# EasyEDA Pro project 智能车.eprj, board PCB1
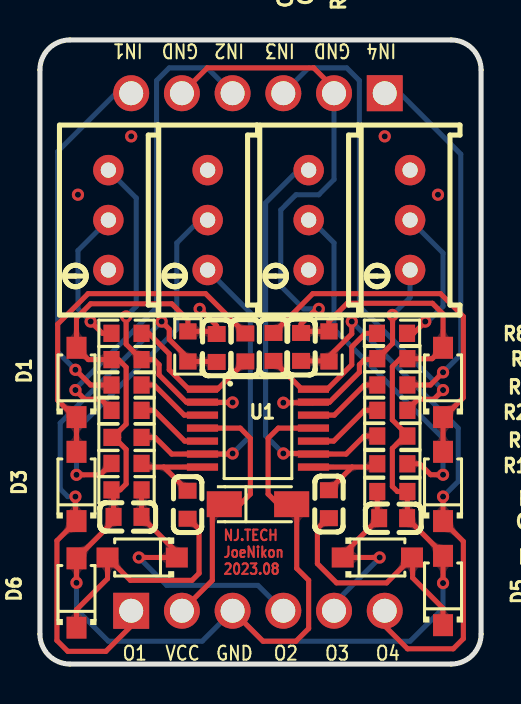
[diagram p10: board, top side]
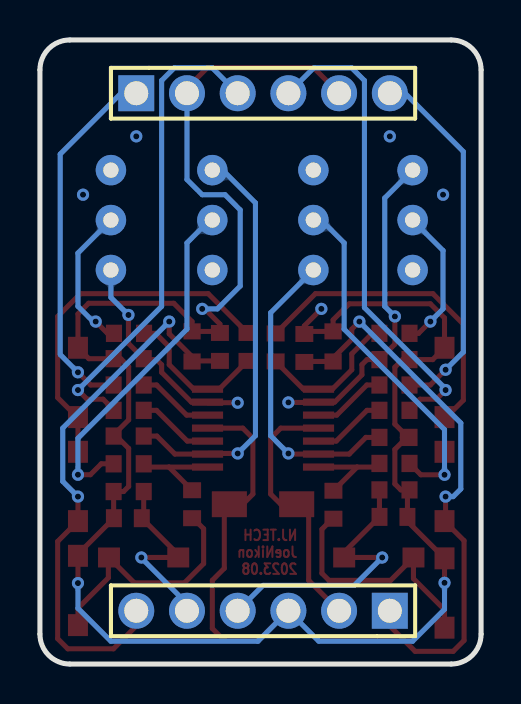
[diagram p11: board, bottom side, seen from below]

Outline 22.1 x 31.24 mm; copper layers: Top Layer, Bottom Layer. Coordinates in mm from the lower left corner of the outline.
Outline path: 0,29.74 0,1.5 arc(0.44,0.44) 1.5,0 20.6,0 arc(21.66,0.44) 22.1,1.5 22.1,29.74 arc(21.66,30.8) 20.6,31.24 1.5,31.24 arc(0.44,30.8) 0,29.74
Stack: Top Layer 0.035mm / Dielectric1 1.51mm FR4 er 4.5 / Bottom Layer 0.035mm

## Design rules (mm)
template: JLCPCB Capability(Two Layers Board)
spacing copperThickness1oz (default): track to track 0.102, other pairs 0.152 to 0.3
spacing copperThickness2oz: track to track 0.203, other pairs 0.152 to 0.3
track width copperThickness1oz (default): min 0.127, default 0.254, max 2.54
track width copperThickness2oz: min 0.203, default 0.254, max 2.54
differential pair differentialPair (default): width min 0.127, default 0.254, max 2.54; gap min 0.152, default 0.152
via viaSize (default): diameter min 0.5, default 0.61, max 10; hole min 0.3, default 0.305, max 6.3

## Placement (name value [footprint] x y rotation side)
C1  100nF  [C0603]  10.29 15.85 90 top
C2  100nF  [C0603]  8.85 15.82 270 top
C3  100nF  [C0603]  13.08 15.88 90 top
C4  100nF  [C0603]  11.7 15.88 90 top
C5  100nF  [C0603]  14.48 8 270 top
C6  100nF  [C0603]  17.69 7.3 180 top
C7  100nF  [C0603]  4.39 7.37 180 top
C8  100nF  [C0603]  7.39 7.97 270 top
D1  B5819W  [SOD-123F_L2.7-W1.6-LS3.8-RD-1]  1.83 14.1 90 top
D2  B5819W  [SOD-123F_L2.7-W1.6-LS3.8-RD-1]  20.19 14.1 90 top
D3  B5819W  [SOD-123F_L2.7-W1.6-LS3.8-RD-1]  1.83 8.89 90 top
D4  B5819W  [SOD-123F_L2.7-W1.6-LS3.8-RD-1]  20.19 8.89 90 top
D5  B5819W  [SOD-123F_L2.7-W1.6-LS3.8-RD-1]  20.19 3.68 90 top
D6  B5819W  [SOD-123F_L2.7-W1.6-LS3.8-RD-1]  1.83 3.56 90 top
D7  B5819W  [SOD-123F_L2.7-W1.6-LS3.8-RD-1]  16.9 5.33 0 top
D8  B5819W  [SOD-123F_L2.7-W1.6-LS3.8-RD-1]  5.12 5.33 180 top
H1  -  [HDR-TH_6P-P2.54-V-M-1]  10.92 2.67 0 bottom
H2  -  [HDR-TH_6P-P2.54-V-M-1]  10.92 28.57 180 bottom
O1  10uF  [CAP-SMD_L3.2-W1.6-RD-C7171]  10.92 8 0 top
R1  1K  [R0603]  4.34 15.24 0 top
R2  100kΩ  [RES-ADJ-TH_3P-L10.0-W10.0-P2.50-L]  3.43 22.22 90 top
R3  47K  [R0603]  4.34 16.55 0 top
R4  47K  [R0603]  7.41 15.9 270 top
R5  47K  [R0603]  14.48 15.9 90 top
R6  1K  [R0603]  17.65 15.28 0 top
R7  100kΩ  [RES-ADJ-TH_3P-L10.0-W10.0-P2.50-L]  18.54 22.22 90 top
R8  47K  [R0603]  17.64 16.55 0 top
R9  1K  [R0603]  17.65 11.41 180 top
R10  100kΩ  [RES-ADJ-TH_3P-L10.0-W10.0-P2.50-L]  13.46 22.22 90 top
R11  47K  [R0603]  17.65 10.02 180 top
R12  47K  [R0603]  17.65 8.64 180 top
R13  47K  [R0603]  4.34 8.72 180 top
R14  1K  [R0603]  4.34 11.35 180 top
R15  100kΩ  [RES-ADJ-TH_3P-L10.0-W10.0-P2.50-L]  8.4 22.22 90 top
R16  47K  [R0603]  4.34 10.04 180 top
R17  5.1K  [R0603]  4.34 12.7 0 top
R18  5.1K  [R0603]  4.34 13.97 0 top
R19  5.1K  [R0603]  17.65 13.97 0 top
R20  5.1K  [R0603]  17.65 12.7 0 top
U1  -  [TSSOP-14_L4.9-W4.4-P0.65-LS6.4-BL]  10.92 11.81 270 top

## Footprints (pads in the part's own frame, mm; a bottom-side part is the same pattern mirrored in y, then rotated)
C0603
  rect 0.8x0.9 smd: 1(-0.7,0) 2(0.7,0)
CAP-SMD_L3.2-W1.6-RD-C7171
  rect 1.758x1.296 smd: 1(-1.687,0) 2(1.687,0)
HDR-TH_6P-P2.54-V-M-1
  rect 1.8x1.8 hole 1.2: 1(-6.35,0)
  round 1.8 hole 1.2: 2(-3.81,0) 3(-1.27,0) 4(1.27,0) 5(3.81,0) 6(6.35,0)
R0603
  rect 0.806x0.864 smd: 1(-0.753,0) 2(0.753,0)
RES-ADJ-TH_3P-L10.0-W10.0-P2.50-L
  round 1.524 hole 0.762: 1(-2.5,0) 2(0,0) 3(2.5,0)
SOD-123F_L2.7-W1.6-LS3.8-RD-1
  rect 1.1x1 smd: 1(-1.735,0) 2(1.735,0)
TSSOP-14_L4.9-W4.4-P0.65-LS6.4-BL
  rect 0.364x1.56 smd: 1(-1.95,-2.78) 2(-1.3,-2.78) 3(-0.65,-2.78) 4(0,-2.78) 5(0.65,-2.78) 6(1.3,-2.78) 7(1.95,-2.78) 8(1.95,2.78) 9(1.3,2.78) 10(0.65,2.78) 11(0,2.78) 12(-0.65,2.78) 13(-1.3,2.78) 14(-1.95,2.78)

## Nets
As in the schematic, except:
GND: C2.1 C3.2 C6.1 C7.2 D1.2 D2.2 D5.2 D6.2 H1.3 H2.2 H2.5 O1.2 R1.1 R4.1 R5.2 R6.2 R9.1 R12.1 R13.2 R14.2 U1.11
VCC: H1.2 O1.1 U1.4

Pads without a net: R2 1; R7 3; R10 1; R15 3

## Via types
v1: diameter 0.61, hole 0.305, Top Layer to Bottom Layer, 28 vias

## Routing (per net, layer and track width the routed paths; a pad name or vN(x,y) marks a point on that pad's centre or on a via; arc(x,y) is an arc through that point)
GND: length 118.6
  Top Layer w0.254: U1.11 11.94,11.81 11.43,11.3 11.43,8.51 11.94,8 O1.2 12.86,7.75 12.86,4.79 13.46,4.19 13.46,1.78 12.83,1.14 11.18,1.14 H1.3 ; 18.18,11.41 18.18,11.7 17.65,12.22 17.65,14.89 18.05,15.28 R6.2 19.65,15.28 D2.2 20.19,17.53 19.66,18.06 15.39,18.06 14.48,17.14 14.48,16.65 13.16,16.65 C3.2 13.08,17.02 13.84,17.78 v1(13.97,17.78) ; 18.18,11.41 18.18,11.32 17.65,10.79 17.65,8.89 17.91,8.64 R12.1 18.41,7.31 18.39,7.3 20.19,5.5 D5.2 v1(20.19,4.05) ; 18.18,11.41 R9.1 ; 3.94,11.35 3.94,11.12 4.32,10.74 4.32,9.02 4.02,8.72 R13.2 3.69,8.61 C7.2 3.69,7.15 D6.2 v1(1.83,4.07) ; 3.94,11.35 3.94,11.64 4.32,12.01 4.32,14.86 3.94,15.24 R1.1 2.42,15.24 D1.2 1.83,17.33 2.54,18.03 6.6,18.03 7.41,17.22 7.41,16.65 8.72,16.65 C2.1 8.85,16.93 v1(8,17.78) ; 3.94,11.35 R14.2 ; H2.5 8.38,29.84 13.72,29.84 14.73,28.83 H2.2
  Bottom Layer w0.254: v1(1.83,4.07) 1.83,2.74 3.43,1.14 8.13,1.14 H1.3 11.18,1.14 18.54,1.14 20.19,2.79 v1(20.19,4.05) ; v1(13.97,17.78) 13.21,17.78 12.06,18.92 12.06,22.73 12.83,23.49 13.97,23.49 14.73,24.26 H2.2
  vias: v1(1.91,23.49) v1(4.57,26.42) v1(17.27,26.42) v1(19.94,23.49)
VCC: length 13.1
  Top Layer w0.254: U1.4 10.03,11.81 10.54,11.3 10.54,8.51 10.03,8 O1.1 8.64,7.4 8.64,4.19 H1.2
IN1: length 18.3
  Top Layer w0.254: R18.1 2.54,13.97 v1(1.78,14.73)
  Bottom Layer w0.254: v1(1.78,14.73) 0.89,15.62 0.89,25.65 3.81,28.57 H2.6
IN2: length 24
  Top Layer w0.254: R17.1 3.58,12.73 3.05,13.26 2.23,13.26 v1(1.78,13.72)
  Bottom Layer w0.254: v1(1.78,13.72) 1.78,13.78 5.84,17.84 5.84,29.21 6.48,29.84 8.38,29.84 H2.4
IN3: length 24.1
  Top Layer w0.254: R20.2 18.41,12.73 18.94,13.26 19.74,13.26 v1(20.19,13.72)
  Bottom Layer w0.254: v1(20.19,13.72) 16,17.91 16,29.21 15.37,29.84 13.46,29.84 H2.3
IN4: length 18.4
  Top Layer w0.254: v1(20.19,14.6) 19.56,13.97 R19.2
  Bottom Layer w0.254: v1(20.19,14.6) 21.08,15.49 21.08,25.53 18.03,28.57 H2.1
OUT1: length 28.3
  Top Layer w0.254: C2.2 8.83,15.15 R4.2 7.41,15.32 6.48,16.25 6.48,16.76 v1(6.1,17.14) ; H1.1 4.57,1.9 3.3,0.63 1.4,0.63 0.85,1.18 0.85,6.18 D3.1 1.78,7.21 v1(1.78,8.38)
  Bottom Layer w0.254: v1(1.78,8.38) 1.4,8.38 1.02,8.76 1.02,12.06 v1(6.1,17.14)
OUT2: length 14.4
  Top Layer w0.254: v1(4.95,5.33) D8.1 6.86,5.6 C7.1 5.09,7.37 5.09,8.72
  Bottom Layer w0.254: v1(4.95,5.33) 6.35,3.94 10.92,3.94 H1.4
OUT3: length 9.6
  Top Layer w0.254: R12.2 16.9,7.39 C6.2 15.17,5.48 D7.1 v1(17.02,5.33)
  Bottom Layer w0.254: v1(17.02,5.33) 17.02,5.31 14.73,3.03 H1.5
OUT4: length 28.1
  Top Layer w0.254: C3.1 14.45,15.17 R5.1 14.48,15.39 15.62,16.53 v1(15.62,17.14) ; H1.6 17.27,1.9 18.41,0.76 20.7,0.76 21.21,1.27 21.21,6.14 D4.1 v1(20.19,8.38)
  Bottom Layer w0.254: v1(15.62,17.14) 20.95,11.81 20.95,9.14 v1(20.19,8.38)
$1N1313: length 16.3
  Top Layer w0.254: v1(4.32,17.4) 4.32,16.01 5.09,15.24 5.72,15.24 5.97,14.99 5.97,14.48 7.34,13.11 U1.2 8.16,13.1 v1(9.65,13.1)
  Bottom Layer w0.254: R2.3 4.83,23.33 4.83,17.91 v1(4.32,17.4)
$1N1314: length 7.3
  Top Layer w0.254: v1(2.54,17.14) 3.13,16.55 R3.1
  Bottom Layer w0.254: v1(2.54,17.14) 1.91,17.78 1.91,20.7 R2.2
$1N1315: length 7.4
  Top Layer w0.254: 5.09,16.55 5.45,16.55 6.48,15.53 6.48,14.73 7.45,13.76 U1.1 8.9,13.76 C1.1
$1N1316: length 17.7
  Top Layer w0.254: D3.2 D1.1 1.73,12.36 0.89,13.21 0.89,17.02 2.41,18.54 8.3,18.54 C1.2
$1N1318: length 18
  Top Layer w0.254: C4.2 13.67,18.54 20.07,18.54 21.21,17.4 21.21,13.33 20.24,12.36 D2.1 D4.2
$1N1320: length 11
  Top Layer w0.254: v1(12.19,13.08) 13.67,13.08 U1.13 14.51,13.11 16,14.6 16,14.99 16.26,15.24 16.85,15.24 R6.1 17.66,16.05 v1(17.66,17.47)
  Bottom Layer w0.254: v1(17.66,17.47) 18.54,18.35 R7.1
$1N1321: length 7.4
  Top Layer w0.254: R8.2 18.71,16.55 v1(19.3,17.14)
  Bottom Layer w0.254: v1(19.3,17.14) 19.43,17.14 20.19,17.91 20.19,20.57 R7.2
$1N1322: length 7.4
  Top Layer w0.254: C4.1 13.12,13.76 U1.14 14.4,13.76 15.62,14.99 15.62,15.88 16.3,16.55 R8.1
$1N1328: length 20.8
  Top Layer w0.254: R9.2 16.24,11.41 15.34,10.51 U1.9 13.67,10.54 v1(12.19,10.54)
  Bottom Layer w0.254: R10.3 12.94,24.72 11.3,23.09 11.3,11.43 v1(12.19,10.54)
$1N1329: length 17.6
  Top Layer w0.254: R11.1 19.03,10.02 19.57,9.48 v1(20.19,9.48)
  Bottom Layer w0.254: R10.2 13.59,22.22 14.73,21.08 14.73,16.76 20.19,11.3 v1(20.19,9.48)
$1N1330: length 4.9
  Top Layer w0.254: U1.8 15.64,9.86 ; 15.64,9.86 16.74,9.86 R11.2 ; 15.64,9.86 C5.1
$1N1331: length 12.2
  Top Layer w0.254: D5.1 20.19,2.79 18.67,4.32 18.67,5.3 D7.2 17.37,4.06 14.86,4.06 13.9,5.02 13.9,6.77 14.43,7.3 C5.2
$1N1333: length 12.4
  Top Layer w0.254: D6.1 1.83,2.72 3.39,4.28 D8.2 4.53,4.19 7.62,4.19 7.97,4.54 7.97,6.75 7.44,7.27 C8.2
$1N1335: length 15.4
  Top Layer w0.254: v1(9.65,10.54) 9.62,10.51 U1.6 6.6,10.51 5.77,11.35 5.09,11.35
  Bottom Layer w0.254: R15.1 10.54,17.59 10.54,11.43 v1(9.65,10.54)
$1N1336: length 17.7
  Top Layer w0.254: v1(1.83,9.47) 3.02,9.47 R16.2
  Bottom Layer w0.254: R15.2 8,22.22 6.86,21.08 6.86,16.76 1.83,11.74 v1(1.83,9.47)
$1N1337: length 4.8
  Top Layer w0.254: 6.21,9.86 5.27,9.86 5.09,10.04 ; 6.21,9.86 C8.1 ; 6.21,9.86 U1.7
$1N1342: length 3.7
  Top Layer w0.254: 5.09,12.7 5.72,12.7 7.25,11.16 U1.5
$1N1343: length 3.7
  Top Layer w0.254: U1.3 7.23,12.46 5.72,13.97 5.09,13.97
$1N1344: length 3.8
  Top Layer w0.254: R19.1 16.26,13.97 14.75,12.46 U1.12
$1N1345: length 3.8
  Top Layer w0.254: U1.10 14.72,11.16 16.26,12.7 R20.1

## Copper pours and planes (outline as drawn; the poured copper is in the pictures)
GND on Top Layer: -2.16,32.02 23.62,32.02 23.62,-2.29 -2.16,-2.29
GND on Bottom Layer: -2.29,32.77 24,32.77 24,-0.89 -2.29,-0.89

Small or netless copper shapes (teardrops, artwork), in the pictures only: 122 on Top Layer, 29 on Bottom Layer

## Text on the board
Top Layer: NJ.TECH / JoeNikon / 2023.08
Top Silkscreen Layer: O1 | VCC | GND | O2 | O3 | O4 | IN1 | IN2 | IN3 | IN4
